# EAGLE schematic Resistor_Resistor (EAGLE 8.3.0), part 34 of 43
## Nets (continued)
N$81: R14401.2 R14402.2 R14403.2 R14404.2 R14405.2 R14406.2 R14407.2 R14408.2 R14409.2 R14410.2 R14411.2 R14412.2 R14413.2 R14414.2 R14415.2 R14416.2 R14417.2 R14418.2 R14419.2 R14420.2 R14421.2 R14422.2 R14423.2 R14424.2 R14425.2 R14426.2 R14427.2 R14428.2 R14429.2 R14430.2 R14431.2 R14432.2 R14433.2 R14434.2 R14435.2 R14436.2 R14437.2 R14438.2 R14439.2 R14440.2 R14441.2 R14442.2 R14443.2 R14444.2 R14445.2 R14446.2 R14447.2 R14448.2 R14449.2 R14450.2 R14451.2 R14452.2 R14453.2 R14454.2 R14455.2 R14456.2 R14457.2 R14458.2 R14459.2 R14460.2 R14461.2 R14462.2 R14463.2 R14464.2 R14465.2 R14466.2 R14467.2 R14468.2 R14469.2 R14470.2 R14471.2 R14472.2 R14473.2 R14474.2 R14475.2 R14476.2 R14477.2 R14478.2 R14479.2 R14480.2 R14481.2 R14482.2 R14483.2 R14484.2 R14485.2 R14486.2 R14487.2 R14488.2 R14489.2 R14490.2 R14491.2 R14492.2 R14493.2 R14494.2 R14495.2 R14496.2 R14497.2 R14498.2 R14499.2 R14500.2 R14501.2 R14502.2 R14503.2 R14504.2 R14505.2 R14506.2 R14507.2 R14508.2 R14509.2 R14510.2 R14511.2 R14512.2 R14513.2 R14514.2 R14515.2 R14516.2 R14517.2 R14518.2 R14519.2 R14520.2 R14521.2 R14522.2 R14523.2 R14524.2 R14525.2 R14526.2 R14527.2 R14528.2 R14529.2 R14530.2 R14531.2 R14532.2 R14533.2 R14534.2 R14535.2 R14536.2 R14537.2 R14538.2 R14539.2 R14540.2 R14541.2 R14542.2 R14543.2 R14544.2 R14545.2 R14546.2 R14547.2 R14548.2 R14549.2 R14550.2 R14551.2 R14552.2 R14553.2 R14554.2 R14555.2 R14556.2 R14557.2 R14558.2 R14559.2 R14560.2 R14561.2 R14562.2 R14563.2 R14564.2 R14565.2 R14566.2 R14567.2 R14568.2 R14569.2 R14570.2 R14571.2 R14572.2 R14573.2 R14574.2 R14575.2 R14576.2 R14577.2 R14578.2 R14579.2 R14580.2 R14581.2 R14582.2 R14583.2 R14584.2 R14585.2 R14586.2 R14587.2 R14588.2 R14589.2 R14590.2 R14591.2 R14592.2 R14593.2 R14594.2 R14595.2 R14596.2 R14597.2 R14598.2 R14599.2 R14600.2 R14601.1 R14602.1 R14603.1 R14604.1 R14605.1 R14606.1 R14607.1 R14608.1 R14609.1 R14610.1 R14611.1 R14612.1 R14613.1 R14614.1 R14615.1 R14616.1 R14617.1 R14618.1 R14619.1 R14620.1 R14621.1 R14622.1 R14623.1 R14624.1 R14625.1 R14626.1 R14627.1 R14628.1 R14629.1 R14630.1 R14631.1 R14632.1 R14633.1 R14634.1 R14635.1 R14636.1 R14637.1 R14638.1 R14639.1 R14640.1 R14641.1 R14642.1 R14643.1 R14644.1 R14645.1 R14646.1 R14647.1 R14648.1 R14649.1 R14650.1 R14651.1 R14652.1 R14653.1 R14654.1 R14655.1 R14656.1 R14657.1 R14658.1 R14659.1 R14660.1 R14661.1 R14662.1 R14663.1 R14664.1 R14665.1 R14666.1 R14667.1 R14668.1 R14669.1 R14670.1 R14671.1 R14672.1 R14673.1 R14674.1 R14675.1 R14676.1 R14677.1 R14678.1 R14679.1 R14680.1 R14681.1 R14682.1 R14683.1 R14684.1 R14685.1 R14686.1 R14687.1 R14688.1 R14689.1 R14690.1 R14691.1 R14692.1 R14693.1 R14694.1 R14695.1 R14696.1 R14697.1 R14698.1 R14699.1 R14700.1 R14701.1 R14702.1 R14703.1 R14704.1 R14705.1 R14706.1 R14707.1 R14708.1 R14709.1 R14710.1 R14711.1 R14712.1 R14713.1 R14714.1 R14715.1 R14716.1 R14717.1 R14718.1 R14719.1 R14720.1 R14721.1 R14722.1 R14723.1 R14724.1 R14725.1 R14726.1 R14727.1 R14728.1 R14729.1 R14730.1 R14731.1 R14732.1 R14733.1 R14734.1 R14735.1 R14736.1 R14737.1 R14738.1 R14739.1 R14740.1 R14741.1 R14742.1 R14743.1 R14744.1 R14745.1 R14746.1 R14747.1 R14748.1 R14749.1 R14750.1 R14751.1 R14752.1 R14753.1 R14754.1 R14755.1 R14756.1 R14757.1 R14758.1 R14759.1 R14760.1 R14761.1 R14762.1 R14763.1 R14764.1 R14765.1 R14766.1 R14767.1 R14768.1 R14769.1 R14770.1 R14771.1 R14772.1 R14773.1 R14774.1 R14775.1 R14776.1 R14777.1 R14778.1 R14779.1 R14780.1 R14781.1 R14782.1 R14783.1 R14784.1 R14785.1 R14786.1 R14787.1 R14788.1 R14789.1 R14790.1 R14791.1 R14792.1 R14793.1 R14794.1 R14795.1 R14796.1 R14797.1 R14798.1 R14799.1 R14800.1
N$82: R14601.2 R14602.2 R14603.2 R14604.2 R14605.2 R14606.2 R14607.2 R14608.2 R14609.2 R14610.2 R14611.2 R14612.2 R14613.2 R14614.2 R14615.2 R14616.2 R14617.2 R14618.2 R14619.2 R14620.2 R14621.2 R14622.2 R14623.2 R14624.2 R14625.2 R14626.2 R14627.2 R14628.2 R14629.2 R14630.2 R14631.2 R14632.2 R14633.2 R14634.2 R14635.2 R14636.2 R14637.2 R14638.2 R14639.2 R14640.2 R14641.2 R14642.2 R14643.2 R14644.2 R14645.2 R14646.2 R14647.2 R14648.2 R14649.2 R14650.2 R14651.2 R14652.2 R14653.2 R14654.2 R14655.2 R14656.2 R14657.2 R14658.2 R14659.2 R14660.2 R14661.2 R14662.2 R14663.2 R14664.2 R14665.2 R14666.2 R14667.2 R14668.2 R14669.2 R14670.2 R14671.2 R14672.2 R14673.2 R14674.2 R14675.2 R14676.2 R14677.2 R14678.2 R14679.2 R14680.2 R14681.2 R14682.2 R14683.2 R14684.2 R14685.2 R14686.2 R14687.2 R14688.2 R14689.2 R14690.2 R14691.2 R14692.2 R14693.2 R14694.2 R14695.2 R14696.2 R14697.2 R14698.2 R14699.2 R14700.2 R14701.2 R14702.2 R14703.2 R14704.2 R14705.2 R14706.2 R14707.2 R14708.2 R14709.2 R14710.2 R14711.2 R14712.2 R14713.2 R14714.2 R14715.2 R14716.2 R14717.2 R14718.2 R14719.2 R14720.2 R14721.2 R14722.2 R14723.2 R14724.2 R14725.2 R14726.2 R14727.2 R14728.2 R14729.2 R14730.2 R14731.2 R14732.2 R14733.2 R14734.2 R14735.2 R14736.2 R14737.2 R14738.2 R14739.2 R14740.2 R14741.2 R14742.2 R14743.2 R14744.2 R14745.2 R14746.2 R14747.2 R14748.2 R14749.2 R14750.2 R14751.2 R14752.2 R14753.2 R14754.2 R14755.2 R14756.2 R14757.2 R14758.2 R14759.2 R14760.2 R14761.2 R14762.2 R14763.2 R14764.2 R14765.2 R14766.2 R14767.2 R14768.2 R14769.2 R14770.2 R14771.2 R14772.2 R14773.2 R14774.2 R14775.2 R14776.2 R14777.2 R14778.2 R14779.2 R14780.2 R14781.2 R14782.2 R14783.2 R14784.2 R14785.2 R14786.2 R14787.2 R14788.2 R14789.2 R14790.2 R14791.2 R14792.2 R14793.2 R14794.2 R14795.2 R14796.2 R14797.2 R14798.2 R14799.2 R14800.2 R14801.1 R14802.1 R14803.1 R14804.1 R14805.1 R14806.1 R14807.1 R14808.1 R14809.1 R14810.1 R14811.1 R14812.1 R14813.1 R14814.1 R14815.1 R14816.1 R14817.1 R14818.1 R14819.1 R14820.1 R14821.1 R14822.1 R14823.1 R14824.1 R14825.1 R14826.1 R14827.1 R14828.1 R14829.1 R14830.1 R14831.1 R14832.1 R14833.1 R14834.1 R14835.1 R14836.1 R14837.1 R14838.1 R14839.1 R14840.1 R14841.1 R14842.1 R14843.1 R14844.1 R14845.1 R14846.1 R14847.1 R14848.1 R14849.1 R14850.1 R14851.1 R14852.1 R14853.1 R14854.1 R14855.1 R14856.1 R14857.1 R14858.1 R14859.1 R14860.1 R14861.1 R14862.1 R14863.1 R14864.1 R14865.1 R14866.1 R14867.1 R14868.1 R14869.1 R14870.1 R14871.1 R14872.1 R14873.1 R14874.1 R14875.1 R14876.1 R14877.1 R14878.1 R14879.1 R14880.1 R14881.1 R14882.1 R14883.1 R14884.1 R14885.1 R14886.1 R14887.1 R14888.1 R14889.1 R14890.1 R14891.1 R14892.1 R14893.1 R14894.1 R14895.1 R14896.1 R14897.1 R14898.1 R14899.1 R14900.1 R14901.1 R14902.1 R14903.1 R14904.1 R14905.1 R14906.1 R14907.1 R14908.1 R14909.1 R14910.1 R14911.1 R14912.1 R14913.1 R14914.1 R14915.1 R14916.1 R14917.1 R14918.1 R14919.1 R14920.1 R14921.1 R14922.1 R14923.1 R14924.1 R14925.1 R14926.1 R14927.1 R14928.1 R14929.1 R14930.1 R14931.1 R14932.1 R14933.1 R14934.1 R14935.1 R14936.1 R14937.1 R14938.1 R14939.1 R14940.1 R14941.1 R14942.1 R14943.1 R14944.1 R14945.1 R14946.1 R14947.1 R14948.1 R14949.1 R14950.1 R14951.1 R14952.1 R14953.1 R14954.1 R14955.1 R14956.1 R14957.1 R14958.1 R14959.1 R14960.1 R14961.1 R14962.1 R14963.1 R14964.1 R14965.1 R14966.1 R14967.1 R14968.1 R14969.1 R14970.1 R14971.1 R14972.1 R14973.1 R14974.1 R14975.1 R14976.1 R14977.1 R14978.1 R14979.1 R14980.1 R14981.1 R14982.1 R14983.1 R14984.1 R14985.1 R14986.1 R14987.1 R14988.1 R14989.1 R14990.1 R14991.1 R14992.1 R14993.1 R14994.1 R14995.1 R14996.1 R14997.1 R14998.1 R14999.1 R15000.1
N$83: R14801.2 R14802.2 R14803.2 R14804.2 R14805.2 R14806.2 R14807.2 R14808.2 R14809.2 R14810.2 R14811.2 R14812.2 R14813.2 R14814.2 R14815.2 R14816.2 R14817.2 R14818.2 R14819.2 R14820.2 R14821.2 R14822.2 R14823.2 R14824.2 R14825.2 R14826.2 R14827.2 R14828.2 R14829.2 R14830.2 R14831.2 R14832.2 R14833.2 R14834.2 R14835.2 R14836.2 R14837.2 R14838.2 R14839.2 R14840.2 R14841.2 R14842.2 R14843.2 R14844.2 R14845.2 R14846.2 R14847.2 R14848.2 R14849.2 R14850.2 R14851.2 R14852.2 R14853.2 R14854.2 R14855.2 R14856.2 R14857.2 R14858.2 R14859.2 R14860.2 R14861.2 R14862.2 R14863.2 R14864.2 R14865.2 R14866.2 R14867.2 R14868.2 R14869.2 R14870.2 R14871.2 R14872.2 R14873.2 R14874.2 R14875.2 R14876.2 R14877.2 R14878.2 R14879.2 R14880.2 R14881.2 R14882.2 R14883.2 R14884.2 R14885.2 R14886.2 R14887.2 R14888.2 R14889.2 R14890.2 R14891.2 R14892.2 R14893.2 R14894.2 R14895.2 R14896.2 R14897.2 R14898.2 R14899.2 R14900.2 R14901.2 R14902.2 R14903.2 R14904.2 R14905.2 R14906.2 R14907.2 R14908.2 R14909.2 R14910.2 R14911.2 R14912.2 R14913.2 R14914.2 R14915.2 R14916.2 R14917.2 R14918.2 R14919.2 R14920.2 R14921.2 R14922.2 R14923.2 R14924.2 R14925.2 R14926.2 R14927.2 R14928.2 R14929.2 R14930.2 R14931.2 R14932.2 R14933.2 R14934.2 R14935.2 R14936.2 R14937.2 R14938.2 R14939.2 R14940.2 R14941.2 R14942.2 R14943.2 R14944.2 R14945.2 R14946.2 R14947.2 R14948.2 R14949.2 R14950.2 R14951.2 R14952.2 R14953.2 R14954.2 R14955.2 R14956.2 R14957.2 R14958.2 R14959.2 R14960.2 R14961.2 R14962.2 R14963.2 R14964.2 R14965.2 R14966.2 R14967.2 R14968.2 R14969.2 R14970.2 R14971.2 R14972.2 R14973.2 R14974.2 R14975.2 R14976.2 R14977.2 R14978.2 R14979.2 R14980.2 R14981.2 R14982.2 R14983.2 R14984.2 R14985.2 R14986.2 R14987.2 R14988.2 R14989.2 R14990.2 R14991.2 R14992.2 R14993.2 R14994.2 R14995.2 R14996.2 R14997.2 R14998.2 R14999.2 R15000.2 R15001.1 R15002.1 R15003.1 R15004.1 R15005.1 R15006.1 R15007.1 R15008.1 R15009.1 R15010.1 R15011.1 R15012.1 R15013.1 R15014.1 R15015.1 R15016.1 R15017.1 R15018.1 R15019.1 R15020.1 R15021.1 R15022.1 R15023.1 R15024.1 R15025.1 R15026.1 R15027.1 R15028.1 R15029.1 R15030.1 R15031.1 R15032.1 R15033.1 R15034.1 R15035.1 R15036.1 R15037.1 R15038.1 R15039.1 R15040.1 R15041.1 R15042.1 R15043.1 R15044.1 R15045.1 R15046.1 R15047.1 R15048.1 R15049.1 R15050.1 R15051.1 R15052.1 R15053.1 R15054.1 R15055.1 R15056.1 R15057.1 R15058.1 R15059.1 R15060.1 R15061.1 R15062.1 R15063.1 R15064.1 R15065.1 R15066.1 R15067.1 R15068.1 R15069.1 R15070.1 R15071.1 R15072.1 R15073.1 R15074.1 R15075.1 R15076.1 R15077.1 R15078.1 R15079.1 R15080.1 R15081.1 R15082.1 R15083.1 R15084.1 R15085.1 R15086.1 R15087.1 R15088.1 R15089.1 R15090.1 R15091.1 R15092.1 R15093.1 R15094.1 R15095.1 R15096.1 R15097.1 R15098.1 R15099.1 R15100.1 R15101.1 R15102.1 R15103.1 R15104.1 R15105.1 R15106.1 R15107.1 R15108.1 R15109.1 R15110.1 R15111.1 R15112.1 R15113.1 R15114.1 R15115.1 R15116.1 R15117.1 R15118.1 R15119.1 R15120.1 R15121.1 R15122.1 R15123.1 R15124.1 R15125.1 R15126.1 R15127.1 R15128.1 R15129.1 R15130.1 R15131.1 R15132.1 R15133.1 R15134.1 R15135.1 R15136.1 R15137.1 R15138.1 R15139.1 R15140.1 R15141.1 R15142.1 R15143.1 R15144.1 R15145.1 R15146.1 R15147.1 R15148.1 R15149.1 R15150.1 R15151.1 R15152.1 R15153.1 R15154.1 R15155.1 R15156.1 R15157.1 R15158.1 R15159.1 R15160.1 R15161.1 R15162.1 R15163.1 R15164.1 R15165.1 R15166.1 R15167.1 R15168.1 R15169.1 R15170.1 R15171.1 R15172.1 R15173.1 R15174.1 R15175.1 R15176.1 R15177.1 R15178.1 R15179.1 R15180.1 R15181.1 R15182.1 R15183.1 R15184.1 R15185.1 R15186.1 R15187.1 R15188.1 R15189.1 R15190.1 R15191.1 R15192.1 R15193.1 R15194.1 R15195.1 R15196.1 R15197.1 R15198.1 R15199.1 R15200.1
N$84: R15001.2 R15002.2 R15003.2 R15004.2 R15005.2 R15006.2 R15007.2 R15008.2 R15009.2 R15010.2 R15011.2 R15012.2 R15013.2 R15014.2 R15015.2 R15016.2 R15017.2 R15018.2 R15019.2 R15020.2 R15021.2 R15022.2 R15023.2 R15024.2 R15025.2 R15026.2 R15027.2 R15028.2 R15029.2 R15030.2 R15031.2 R15032.2 R15033.2 R15034.2 R15035.2 R15036.2 R15037.2 R15038.2 R15039.2 R15040.2 R15041.2 R15042.2 R15043.2 R15044.2 R15045.2 R15046.2 R15047.2 R15048.2 R15049.2 R15050.2 R15051.2 R15052.2 R15053.2 R15054.2 R15055.2 R15056.2 R15057.2 R15058.2 R15059.2 R15060.2 R15061.2 R15062.2 R15063.2 R15064.2 R15065.2 R15066.2 R15067.2 R15068.2 R15069.2 R15070.2 R15071.2 R15072.2 R15073.2 R15074.2 R15075.2 R15076.2 R15077.2 R15078.2 R15079.2 R15080.2 R15081.2 R15082.2 R15083.2 R15084.2 R15085.2 R15086.2 R15087.2 R15088.2 R15089.2 R15090.2 R15091.2 R15092.2 R15093.2 R15094.2 R15095.2 R15096.2 R15097.2 R15098.2 R15099.2 R15100.2 R15101.2 R15102.2 R15103.2 R15104.2 R15105.2 R15106.2 R15107.2 R15108.2 R15109.2 R15110.2 R15111.2 R15112.2 R15113.2 R15114.2 R15115.2 R15116.2 R15117.2 R15118.2 R15119.2 R15120.2 R15121.2 R15122.2 R15123.2 R15124.2 R15125.2 R15126.2 R15127.2 R15128.2 R15129.2 R15130.2 R15131.2 R15132.2 R15133.2 R15134.2 R15135.2 R15136.2 R15137.2 R15138.2 R15139.2 R15140.2 R15141.2 R15142.2 R15143.2 R15144.2 R15145.2 R15146.2 R15147.2 R15148.2 R15149.2 R15150.2 R15151.2 R15152.2 R15153.2 R15154.2 R15155.2 R15156.2 R15157.2 R15158.2 R15159.2 R15160.2 R15161.2 R15162.2 R15163.2 R15164.2 R15165.2 R15166.2 R15167.2 R15168.2 R15169.2 R15170.2 R15171.2 R15172.2 R15173.2 R15174.2 R15175.2 R15176.2 R15177.2 R15178.2 R15179.2 R15180.2 R15181.2 R15182.2 R15183.2 R15184.2 R15185.2 R15186.2 R15187.2 R15188.2 R15189.2 R15190.2 R15191.2 R15192.2 R15193.2 R15194.2 R15195.2 R15196.2 R15197.2 R15198.2 R15199.2 R15200.2 R15201.1 R15202.1 R15203.1 R15204.1 R15205.1 R15206.1 R15207.1 R15208.1 R15209.1 R15210.1 R15211.1 R15212.1 R15213.1 R15214.1 R15215.1 R15216.1 R15217.1 R15218.1 R15219.1 R15220.1 R15221.1 R15222.1 R15223.1 R15224.1 R15225.1 R15226.1 R15227.1 R15228.1 R15229.1 R15230.1 R15231.1 R15232.1 R15233.1 R15234.1 R15235.1 R15236.1 R15237.1 R15238.1 R15239.1 R15240.1 R15241.1 R15242.1 R15243.1 R15244.1 R15245.1 R15246.1 R15247.1 R15248.1 R15249.1 R15250.1 R15251.1 R15252.1 R15253.1 R15254.1 R15255.1 R15256.1 R15257.1 R15258.1 R15259.1 R15260.1 R15261.1 R15262.1 R15263.1 R15264.1 R15265.1 R15266.1 R15267.1 R15268.1 R15269.1 R15270.1 R15271.1 R15272.1 R15273.1 R15274.1 R15275.1 R15276.1 R15277.1 R15278.1 R15279.1 R15280.1 R15281.1 R15282.1 R15283.1 R15284.1 R15285.1 R15286.1 R15287.1 R15288.1 R15289.1 R15290.1 R15291.1 R15292.1 R15293.1 R15294.1 R15295.1 R15296.1 R15297.1 R15298.1 R15299.1 R15300.1 R15301.1 R15302.1 R15303.1 R15304.1 R15305.1 R15306.1 R15307.1 R15308.1 R15309.1 R15310.1 R15311.1 R15312.1 R15313.1 R15314.1 R15315.1 R15316.1 R15317.1 R15318.1 R15319.1 R15320.1 R15321.1 R15322.1 R15323.1 R15324.1 R15325.1 R15326.1 R15327.1 R15328.1 R15329.1 R15330.1 R15331.1 R15332.1 R15333.1 R15334.1 R15335.1 R15336.1 R15337.1 R15338.1 R15339.1 R15340.1 R15341.1 R15342.1 R15343.1 R15344.1 R15345.1 R15346.1 R15347.1 R15348.1 R15349.1 R15350.1 R15351.1 R15352.1 R15353.1 R15354.1 R15355.1 R15356.1 R15357.1 R15358.1 R15359.1 R15360.1 R15361.1 R15362.1 R15363.1 R15364.1 R15365.1 R15366.1 R15367.1 R15368.1 R15369.1 R15370.1 R15371.1 R15372.1 R15373.1 R15374.1 R15375.1 R15376.1 R15377.1 R15378.1 R15379.1 R15380.1 R15381.1 R15382.1 R15383.1 R15384.1 R15385.1 R15386.1 R15387.1 R15388.1 R15389.1 R15390.1 R15391.1 R15392.1 R15393.1 R15394.1 R15395.1 R15396.1 R15397.1 R15398.1 R15399.1 R15400.1
N$85: R15201.2 R15202.2 R15203.2 R15204.2 R15205.2 R15206.2 R15207.2 R15208.2 R15209.2 R15210.2 R15211.2 R15212.2 R15213.2 R15214.2 R15215.2 R15216.2 R15217.2 R15218.2 R15219.2 R15220.2 R15221.2 R15222.2 R15223.2 R15224.2 R15225.2 R15226.2 R15227.2 R15228.2 R15229.2 R15230.2 R15231.2 R15232.2 R15233.2 R15234.2 R15235.2 R15236.2 R15237.2 R15238.2 R15239.2 R15240.2 R15241.2 R15242.2 R15243.2 R15244.2 R15245.2 R15246.2 R15247.2 R15248.2 R15249.2 R15250.2 R15251.2 R15252.2 R15253.2 R15254.2 R15255.2 R15256.2 R15257.2 R15258.2 R15259.2 R15260.2 R15261.2 R15262.2 R15263.2 R15264.2 R15265.2 R15266.2 R15267.2 R15268.2 R15269.2 R15270.2 R15271.2 R15272.2 R15273.2 R15274.2 R15275.2 R15276.2 R15277.2 R15278.2 R15279.2 R15280.2 R15281.2 R15282.2 R15283.2 R15284.2 R15285.2 R15286.2 R15287.2 R15288.2 R15289.2 R15290.2 R15291.2 R15292.2 R15293.2 R15294.2 R15295.2 R15296.2 R15297.2 R15298.2 R15299.2 R15300.2 R15301.2 R15302.2 R15303.2 R15304.2 R15305.2 R15306.2 R15307.2 R15308.2 R15309.2 R15310.2 R15311.2 R15312.2 R15313.2 R15314.2 R15315.2 R15316.2 R15317.2 R15318.2 R15319.2 R15320.2 R15321.2 R15322.2 R15323.2 R15324.2 R15325.2 R15326.2 R15327.2 R15328.2 R15329.2 R15330.2 R15331.2 R15332.2 R15333.2 R15334.2 R15335.2 R15336.2 R15337.2 R15338.2 R15339.2 R15340.2 R15341.2 R15342.2 R15343.2 R15344.2 R15345.2 R15346.2 R15347.2 R15348.2 R15349.2 R15350.2 R15351.2 R15352.2 R15353.2 R15354.2 R15355.2 R15356.2 R15357.2 R15358.2 R15359.2 R15360.2 R15361.2 R15362.2 R15363.2 R15364.2 R15365.2 R15366.2 R15367.2 R15368.2 R15369.2 R15370.2 R15371.2 R15372.2 R15373.2 R15374.2 R15375.2 R15376.2 R15377.2 R15378.2 R15379.2 R15380.2 R15381.2 R15382.2 R15383.2 R15384.2 R15385.2 R15386.2 R15387.2 R15388.2 R15389.2 R15390.2 R15391.2 R15392.2 R15393.2 R15394.2 R15395.2 R15396.2 R15397.2 R15398.2 R15399.2 R15400.2 R15401.1 R15402.1 R15403.1 R15404.1 R15405.1 R15406.1 R15407.1 R15408.1 R15409.1 R15410.1 R15411.1 R15412.1 R15413.1 R15414.1 R15415.1 R15416.1 R15417.1 R15418.1 R15419.1 R15420.1 R15421.1 R15422.1 R15423.1 R15424.1 R15425.1 R15426.1 R15427.1 R15428.1 R15429.1 R15430.1 R15431.1 R15432.1 R15433.1 R15434.1 R15435.1 R15436.1 R15437.1 R15438.1 R15439.1 R15440.1 R15441.1 R15442.1 R15443.1 R15444.1 R15445.1 R15446.1 R15447.1 R15448.1 R15449.1 R15450.1 R15451.1 R15452.1 R15453.1 R15454.1 R15455.1 R15456.1 R15457.1 R15458.1 R15459.1 R15460.1 R15461.1 R15462.1 R15463.1 R15464.1 R15465.1 R15466.1 R15467.1 R15468.1 R15469.1 R15470.1 R15471.1 R15472.1 R15473.1 R15474.1 R15475.1 R15476.1 R15477.1 R15478.1 R15479.1 R15480.1 R15481.1 R15482.1 R15483.1 R15484.1 R15485.1 R15486.1 R15487.1 R15488.1 R15489.1 R15490.1 R15491.1 R15492.1 R15493.1 R15494.1 R15495.1 R15496.1 R15497.1 R15498.1 R15499.1 R15500.1 R15501.1 R15502.1 R15503.1 R15504.1 R15505.1 R15506.1 R15507.1 R15508.1 R15509.1 R15510.1 R15511.1 R15512.1 R15513.1 R15514.1 R15515.1 R15516.1 R15517.1 R15518.1 R15519.1 R15520.1 R15521.1 R15522.1 R15523.1 R15524.1 R15525.1 R15526.1 R15527.1 R15528.1 R15529.1 R15530.1 R15531.1 R15532.1 R15533.1 R15534.1 R15535.1 R15536.1 R15537.1 R15538.1 R15539.1 R15540.1 R15541.1 R15542.1 R15543.1 R15544.1 R15545.1 R15546.1 R15547.1 R15548.1 R15549.1 R15550.1 R15551.1 R15552.1 R15553.1 R15554.1 R15555.1 R15556.1 R15557.1 R15558.1 R15559.1 R15560.1 R15561.1 R15562.1 R15563.1 R15564.1 R15565.1 R15566.1 R15567.1 R15568.1 R15569.1 R15570.1 R15571.1 R15572.1 R15573.1 R15574.1 R15575.1 R15576.1 R15577.1 R15578.1 R15579.1 R15580.1 R15581.1 R15582.1 R15583.1 R15584.1 R15585.1 R15586.1 R15587.1 R15588.1 R15589.1 R15590.1 R15591.1 R15592.1 R15593.1 R15594.1 R15595.1 R15596.1 R15597.1 R15598.1 R15599.1 R15600.1
N$86: R15401.2 R15402.2 R15403.2 R15404.2 R15405.2 R15406.2 R15407.2 R15408.2 R15409.2 R15410.2 R15411.2 R15412.2 R15413.2 R15414.2 R15415.2 R15416.2 R15417.2 R15418.2 R15419.2 R15420.2 R15421.2 R15422.2 R15423.2 R15424.2 R15425.2 R15426.2 R15427.2 R15428.2 R15429.2 R15430.2 R15431.2 R15432.2 R15433.2 R15434.2 R15435.2 R15436.2 R15437.2 R15438.2 R15439.2 R15440.2 R15441.2 R15442.2 R15443.2 R15444.2 R15445.2 R15446.2 R15447.2 R15448.2 R15449.2 R15450.2 R15451.2 R15452.2 R15453.2 R15454.2 R15455.2 R15456.2 R15457.2 R15458.2 R15459.2 R15460.2 R15461.2 R15462.2 R15463.2 R15464.2 R15465.2 R15466.2 R15467.2 R15468.2 R15469.2 R15470.2 R15471.2 R15472.2 R15473.2 R15474.2 R15475.2 R15476.2 R15477.2 R15478.2 R15479.2 R15480.2 R15481.2 R15482.2 R15483.2 R15484.2 R15485.2 R15486.2 R15487.2 R15488.2 R15489.2 R15490.2 R15491.2 R15492.2 R15493.2 R15494.2 R15495.2 R15496.2 R15497.2 R15498.2 R15499.2 R15500.2 R15501.2 R15502.2 R15503.2 R15504.2 R15505.2 R15506.2 R15507.2 R15508.2 R15509.2 R15510.2 R15511.2 R15512.2 R15513.2 R15514.2 R15515.2 R15516.2 R15517.2 R15518.2 R15519.2 R15520.2 R15521.2 R15522.2 R15523.2 R15524.2 R15525.2 R15526.2 R15527.2 R15528.2 R15529.2 R15530.2 R15531.2 R15532.2 R15533.2 R15534.2 R15535.2 R15536.2 R15537.2 R15538.2 R15539.2 R15540.2 R15541.2 R15542.2 R15543.2 R15544.2 R15545.2 R15546.2 R15547.2 R15548.2 R15549.2 R15550.2 R15551.2 R15552.2 R15553.2 R15554.2 R15555.2 R15556.2 R15557.2 R15558.2 R15559.2 R15560.2 R15561.2 R15562.2 R15563.2 R15564.2 R15565.2 R15566.2 R15567.2 R15568.2 R15569.2 R15570.2 R15571.2 R15572.2 R15573.2 R15574.2 R15575.2 R15576.2 R15577.2 R15578.2 R15579.2 R15580.2 R15581.2 R15582.2 R15583.2 R15584.2 R15585.2 R15586.2 R15587.2 R15588.2 R15589.2 R15590.2 R15591.2 R15592.2 R15593.2 R15594.2 R15595.2 R15596.2 R15597.2 R15598.2 R15599.2 R15600.2 R15601.1 R15602.1 R15603.1 R15604.1 R15605.1 R15606.1 R15607.1 R15608.1 R15609.1 R15610.1 R15611.1 R15612.1 R15613.1 R15614.1 R15615.1 R15616.1 R15617.1 R15618.1 R15619.1 R15620.1 R15621.1 R15622.1 R15623.1 R15624.1 R15625.1 R15626.1 R15627.1 R15628.1 R15629.1 R15630.1 R15631.1 R15632.1 R15633.1 R15634.1 R15635.1 R15636.1 R15637.1 R15638.1 R15639.1 R15640.1 R15641.1 R15642.1 R15643.1 R15644.1 R15645.1 R15646.1 R15647.1 R15648.1 R15649.1 R15650.1 R15651.1 R15652.1 R15653.1 R15654.1 R15655.1 R15656.1 R15657.1 R15658.1 R15659.1 R15660.1 R15661.1 R15662.1 R15663.1 R15664.1 R15665.1 R15666.1 R15667.1 R15668.1 R15669.1 R15670.1 R15671.1 R15672.1 R15673.1 R15674.1 R15675.1 R15676.1 R15677.1 R15678.1 R15679.1 R15680.1 R15681.1 R15682.1 R15683.1 R15684.1 R15685.1 R15686.1 R15687.1 R15688.1 R15689.1 R15690.1 R15691.1 R15692.1 R15693.1 R15694.1 R15695.1 R15696.1 R15697.1 R15698.1 R15699.1 R15700.1 R15701.1 R15702.1 R15703.1 R15704.1 R15705.1 R15706.1 R15707.1 R15708.1 R15709.1 R15710.1 R15711.1 R15712.1 R15713.1 R15714.1 R15715.1 R15716.1 R15717.1 R15718.1 R15719.1 R15720.1 R15721.1 R15722.1 R15723.1 R15724.1 R15725.1 R15726.1 R15727.1 R15728.1 R15729.1 R15730.1 R15731.1 R15732.1 R15733.1 R15734.1 R15735.1 R15736.1 R15737.1 R15738.1 R15739.1 R15740.1 R15741.1 R15742.1 R15743.1 R15744.1 R15745.1 R15746.1 R15747.1 R15748.1 R15749.1 R15750.1 R15751.1 R15752.1 R15753.1 R15754.1 R15755.1 R15756.1 R15757.1 R15758.1 R15759.1 R15760.1 R15761.1 R15762.1 R15763.1 R15764.1 R15765.1 R15766.1 R15767.1 R15768.1 R15769.1 R15770.1 R15771.1 R15772.1 R15773.1 R15774.1 R15775.1 R15776.1 R15777.1 R15778.1 R15779.1 R15780.1 R15781.1 R15782.1 R15783.1 R15784.1 R15785.1 R15786.1 R15787.1 R15788.1 R15789.1 R15790.1 R15791.1 R15792.1 R15793.1 R15794.1 R15795.1 R15796.1 R15797.1 R15798.1 R15799.1 R15800.1
N$87: R15601.2 R15602.2 R15603.2 R15604.2 R15605.2 R15606.2 R15607.2 R15608.2 R15609.2 R15610.2 R15611.2 R15612.2 R15613.2 R15614.2 R15615.2 R15616.2 R15617.2 R15618.2 R15619.2 R15620.2 R15621.2 R15622.2 R15623.2 R15624.2 R15625.2 R15626.2 R15627.2 R15628.2 R15629.2 R15630.2 R15631.2 R15632.2 R15633.2 R15634.2 R15635.2 R15636.2 R15637.2 R15638.2 R15639.2 R15640.2 R15641.2 R15642.2 R15643.2 R15644.2 R15645.2 R15646.2 R15647.2 R15648.2 R15649.2 R15650.2 R15651.2 R15652.2 R15653.2 R15654.2 R15655.2 R15656.2 R15657.2 R15658.2 R15659.2 R15660.2 R15661.2 R15662.2 R15663.2 R15664.2 R15665.2 R15666.2 R15667.2 R15668.2 R15669.2 R15670.2 R15671.2 R15672.2 R15673.2 R15674.2 R15675.2 R15676.2 R15677.2 R15678.2 R15679.2 R15680.2 R15681.2 R15682.2 R15683.2 R15684.2 R15685.2 R15686.2 R15687.2 R15688.2 R15689.2 R15690.2 R15691.2 R15692.2 R15693.2 R15694.2 R15695.2 R15696.2 R15697.2 R15698.2 R15699.2 R15700.2 R15701.2 R15702.2 R15703.2 R15704.2 R15705.2 R15706.2 R15707.2 R15708.2 R15709.2 R15710.2 R15711.2 R15712.2 R15713.2 R15714.2 R15715.2 R15716.2 R15717.2 R15718.2 R15719.2 R15720.2 R15721.2 R15722.2 R15723.2 R15724.2 R15725.2 R15726.2 R15727.2 R15728.2 R15729.2 R15730.2 R15731.2 R15732.2 R15733.2 R15734.2 R15735.2 R15736.2 R15737.2 R15738.2 R15739.2 R15740.2 R15741.2 R15742.2 R15743.2 R15744.2 R15745.2 R15746.2 R15747.2 R15748.2 R15749.2 R15750.2 R15751.2 R15752.2 R15753.2 R15754.2 R15755.2 R15756.2 R15757.2 R15758.2 R15759.2 R15760.2 R15761.2 R15762.2 R15763.2 R15764.2 R15765.2 R15766.2 R15767.2 R15768.2 R15769.2 R15770.2 R15771.2 R15772.2 R15773.2 R15774.2 R15775.2 R15776.2 R15777.2 R15778.2 R15779.2 R15780.2 R15781.2 R15782.2 R15783.2 R15784.2 R15785.2 R15786.2 R15787.2 R15788.2 R15789.2 R15790.2 R15791.2 R15792.2 R15793.2 R15794.2 R15795.2 R15796.2 R15797.2 R15798.2 R15799.2 R15800.2 R15801.1 R15802.1 R15803.1 R15804.1 R15805.1 R15806.1 R15807.1 R15808.1 R15809.1 R15810.1 R15811.1 R15812.1 R15813.1 R15814.1 R15815.1 R15816.1 R15817.1 R15818.1 R15819.1 R15820.1 R15821.1 R15822.1 R15823.1 R15824.1 R15825.1 R15826.1 R15827.1 R15828.1 R15829.1 R15830.1 R15831.1 R15832.1 R15833.1 R15834.1 R15835.1 R15836.1 R15837.1 R15838.1 R15839.1 R15840.1 R15841.1 R15842.1 R15843.1 R15844.1 R15845.1 R15846.1 R15847.1 R15848.1 R15849.1 R15850.1 R15851.1 R15852.1 R15853.1 R15854.1 R15855.1 R15856.1 R15857.1 R15858.1 R15859.1 R15860.1 R15861.1 R15862.1 R15863.1 R15864.1 R15865.1 R15866.1 R15867.1 R15868.1 R15869.1 R15870.1 R15871.1 R15872.1 R15873.1 R15874.1 R15875.1 R15876.1 R15877.1 R15878.1 R15879.1 R15880.1 R15881.1 R15882.1 R15883.1 R15884.1 R15885.1 R15886.1 R15887.1 R15888.1 R15889.1 R15890.1 R15891.1 R15892.1 R15893.1 R15894.1 R15895.1 R15896.1 R15897.1 R15898.1 R15899.1 R15900.1 R15901.1 R15902.1 R15903.1 R15904.1 R15905.1 R15906.1 R15907.1 R15908.1 R15909.1 R15910.1 R15911.1 R15912.1 R15913.1 R15914.1 R15915.1 R15916.1 R15917.1 R15918.1 R15919.1 R15920.1 R15921.1 R15922.1 R15923.1 R15924.1 R15925.1 R15926.1 R15927.1 R15928.1 R15929.1 R15930.1 R15931.1 R15932.1 R15933.1 R15934.1 R15935.1 R15936.1 R15937.1 R15938.1 R15939.1 R15940.1 R15941.1 R15942.1 R15943.1 R15944.1 R15945.1 R15946.1 R15947.1 R15948.1 R15949.1 R15950.1 R15951.1 R15952.1 R15953.1 R15954.1 R15955.1 R15956.1 R15957.1 R15958.1 R15959.1 R15960.1 R15961.1 R15962.1 R15963.1 R15964.1 R15965.1 R15966.1 R15967.1 R15968.1 R15969.1 R15970.1 R15971.1 R15972.1 R15973.1 R15974.1 R15975.1 R15976.1 R15977.1 R15978.1 R15979.1 R15980.1 R15981.1 R15982.1 R15983.1 R15984.1 R15985.1 R15986.1 R15987.1 R15988.1 R15989.1 R15990.1 R15991.1 R15992.1 R15993.1 R15994.1 R15995.1 R15996.1 R15997.1 R15998.1 R15999.1 R16000.1
N$88: R15801.2 R15802.2 R15803.2 R15804.2 R15805.2 R15806.2 R15807.2 R15808.2 R15809.2 R15810.2 R15811.2 R15812.2 R15813.2 R15814.2 R15815.2 R15816.2 R15817.2 R15818.2 R15819.2 R15820.2 R15821.2 R15822.2 R15823.2 R15824.2 R15825.2 R15826.2 R15827.2 R15828.2 R15829.2 R15830.2 R15831.2 R15832.2 R15833.2 R15834.2 R15835.2 R15836.2 R15837.2 R15838.2 R15839.2 R15840.2 R15841.2 R15842.2 R15843.2 R15844.2 R15845.2 R15846.2 R15847.2 R15848.2 R15849.2 R15850.2 R15851.2 R15852.2 R15853.2 R15854.2 R15855.2 R15856.2 R15857.2 R15858.2 R15859.2 R15860.2 R15861.2 R15862.2 R15863.2 R15864.2 R15865.2 R15866.2 R15867.2 R15868.2 R15869.2 R15870.2 R15871.2 R15872.2 R15873.2 R15874.2 R15875.2 R15876.2 R15877.2 R15878.2 R15879.2 R15880.2 R15881.2 R15882.2 R15883.2 R15884.2 R15885.2 R15886.2 R15887.2 R15888.2 R15889.2 R15890.2 R15891.2 R15892.2 R15893.2 R15894.2 R15895.2 R15896.2 R15897.2 R15898.2 R15899.2 R15900.2 R15901.2 R15902.2 R15903.2 R15904.2 R15905.2 R15906.2 R15907.2 R15908.2 R15909.2 R15910.2 R15911.2 R15912.2 R15913.2 R15914.2 R15915.2 R15916.2 R15917.2 R15918.2 R15919.2 R15920.2 R15921.2 R15922.2 R15923.2 R15924.2 R15925.2 R15926.2 R15927.2 R15928.2 R15929.2 R15930.2 R15931.2 R15932.2 R15933.2 R15934.2 R15935.2 R15936.2 R15937.2 R15938.2 R15939.2 R15940.2 R15941.2 R15942.2 R15943.2 R15944.2 R15945.2 R15946.2 R15947.2 R15948.2 R15949.2 R15950.2 R15951.2 R15952.2 R15953.2 R15954.2 R15955.2 R15956.2 R15957.2 R15958.2 R15959.2 R15960.2 R15961.2 R15962.2 R15963.2 R15964.2 R15965.2 R15966.2 R15967.2 R15968.2 R15969.2 R15970.2 R15971.2 R15972.2 R15973.2 R15974.2 R15975.2 R15976.2 R15977.2 R15978.2 R15979.2 R15980.2 R15981.2 R15982.2 R15983.2 R15984.2 R15985.2 R15986.2 R15987.2 R15988.2 R15989.2 R15990.2 R15991.2 R15992.2 R15993.2 R15994.2 R15995.2 R15996.2 R15997.2 R15998.2 R15999.2 R16000.2 R16001.1 R16002.1 R16003.1 R16004.1 R16005.1 R16006.1 R16007.1 R16008.1 R16009.1 R16010.1 R16011.1 R16012.1 R16013.1 R16014.1 R16015.1 R16016.1 R16017.1 R16018.1 R16019.1 R16020.1 R16021.1 R16022.1 R16023.1 R16024.1 R16025.1 R16026.1 R16027.1 R16028.1 R16029.1 R16030.1 R16031.1 R16032.1 R16033.1 R16034.1 R16035.1 R16036.1 R16037.1 R16038.1 R16039.1 R16040.1 R16041.1 R16042.1 R16043.1 R16044.1 R16045.1 R16046.1 R16047.1 R16048.1 R16049.1 R16050.1 R16051.1 R16052.1 R16053.1 R16054.1 R16055.1 R16056.1 R16057.1 R16058.1 R16059.1 R16060.1 R16061.1 R16062.1 R16063.1 R16064.1 R16065.1 R16066.1 R16067.1 R16068.1 R16069.1 R16070.1 R16071.1 R16072.1 R16073.1 R16074.1 R16075.1 R16076.1 R16077.1 R16078.1 R16079.1 R16080.1 R16081.1 R16082.1 R16083.1 R16084.1 R16085.1 R16086.1 R16087.1 R16088.1 R16089.1 R16090.1 R16091.1 R16092.1 R16093.1 R16094.1 R16095.1 R16096.1 R16097.1 R16098.1 R16099.1 R16100.1 R16101.1 R16102.1 R16103.1 R16104.1 R16105.1 R16106.1 R16107.1 R16108.1 R16109.1 R16110.1 R16111.1 R16112.1 R16113.1 R16114.1 R16115.1 R16116.1 R16117.1 R16118.1 R16119.1 R16120.1 R16121.1 R16122.1 R16123.1 R16124.1 R16125.1 R16126.1 R16127.1 R16128.1 R16129.1 R16130.1 R16131.1 R16132.1 R16133.1 R16134.1 R16135.1 R16136.1 R16137.1 R16138.1 R16139.1 R16140.1 R16141.1 R16142.1 R16143.1 R16144.1 R16145.1 R16146.1 R16147.1 R16148.1 R16149.1 R16150.1 R16151.1 R16152.1 R16153.1 R16154.1 R16155.1 R16156.1 R16157.1 R16158.1 R16159.1 R16160.1 R16161.1 R16162.1 R16163.1 R16164.1 R16165.1 R16166.1 R16167.1 R16168.1 R16169.1 R16170.1 R16171.1 R16172.1 R16173.1 R16174.1 R16175.1 R16176.1 R16177.1 R16178.1 R16179.1 R16180.1 R16181.1 R16182.1 R16183.1 R16184.1 R16185.1 R16186.1 R16187.1 R16188.1 R16189.1 R16190.1 R16191.1 R16192.1 R16193.1 R16194.1 R16195.1 R16196.1 R16197.1 R16198.1 R16199.1 R16200.1
N$89: R16001.2 R16002.2 R16003.2 R16004.2 R16005.2 R16006.2 R16007.2 R16008.2 R16009.2 R16010.2 R16011.2 R16012.2 R16013.2 R16014.2 R16015.2 R16016.2 R16017.2 R16018.2 R16019.2 R16020.2 R16021.2 R16022.2 R16023.2 R16024.2 R16025.2 R16026.2 R16027.2 R16028.2 R16029.2 R16030.2 R16031.2 R16032.2 R16033.2 R16034.2 R16035.2 R16036.2 R16037.2 R16038.2 R16039.2 R16040.2 R16041.2 R16042.2 R16043.2 R16044.2 R16045.2 R16046.2 R16047.2 R16048.2 R16049.2 R16050.2 R16051.2 R16052.2 R16053.2 R16054.2 R16055.2 R16056.2 R16057.2 R16058.2 R16059.2 R16060.2 R16061.2 R16062.2 R16063.2 R16064.2 R16065.2 R16066.2 R16067.2 R16068.2 R16069.2 R16070.2 R16071.2 R16072.2 R16073.2 R16074.2 R16075.2 R16076.2 R16077.2 R16078.2 R16079.2 R16080.2 R16081.2 R16082.2 R16083.2 R16084.2 R16085.2 R16086.2 R16087.2 R16088.2 R16089.2 R16090.2 R16091.2 R16092.2 R16093.2 R16094.2 R16095.2 R16096.2 R16097.2 R16098.2 R16099.2 R16100.2 R16101.2 R16102.2 R16103.2 R16104.2 R16105.2 R16106.2 R16107.2 R16108.2 R16109.2 R16110.2 R16111.2 R16112.2 R16113.2 R16114.2 R16115.2 R16116.2 R16117.2 R16118.2 R16119.2 R16120.2 R16121.2 R16122.2 R16123.2 R16124.2 R16125.2 R16126.2 R16127.2 R16128.2 R16129.2 R16130.2 R16131.2 R16132.2 R16133.2 R16134.2 R16135.2 R16136.2 R16137.2 R16138.2 R16139.2 R16140.2 R16141.2 R16142.2 R16143.2 R16144.2 R16145.2 R16146.2 R16147.2 R16148.2 R16149.2 R16150.2 R16151.2 R16152.2 R16153.2 R16154.2 R16155.2 R16156.2 R16157.2 R16158.2 R16159.2 R16160.2 R16161.2 R16162.2 R16163.2 R16164.2 R16165.2 R16166.2 R16167.2 R16168.2 R16169.2 R16170.2 R16171.2 R16172.2 R16173.2 R16174.2 R16175.2 R16176.2 R16177.2 R16178.2 R16179.2 R16180.2 R16181.2 R16182.2 R16183.2 R16184.2 R16185.2 R16186.2 R16187.2 R16188.2 R16189.2 R16190.2 R16191.2 R16192.2 R16193.2 R16194.2 R16195.2 R16196.2 R16197.2 R16198.2 R16199.2 R16200.2 R16201.1 R16202.1 R16203.1 R16204.1 R16205.1 R16206.1 R16207.1 R16208.1 R16209.1 R16210.1 R16211.1 R16212.1 R16213.1 R16214.1 R16215.1 R16216.1 R16217.1 R16218.1 R16219.1 R16220.1 R16221.1 R16222.1 R16223.1 R16224.1 R16225.1 R16226.1 R16227.1 R16228.1 R16229.1 R16230.1 R16231.1 R16232.1 R16233.1 R16234.1 R16235.1 R16236.1 R16237.1 R16238.1 R16239.1 R16240.1 R16241.1 R16242.1 R16243.1 R16244.1 R16245.1 R16246.1 R16247.1 R16248.1 R16249.1 R16250.1 R16251.1 R16252.1 R16253.1 R16254.1 R16255.1 R16256.1 R16257.1 R16258.1 R16259.1 R16260.1 R16261.1 R16262.1 R16263.1 R16264.1 R16265.1 R16266.1 R16267.1 R16268.1 R16269.1 R16270.1 R16271.1 R16272.1 R16273.1 R16274.1 R16275.1 R16276.1 R16277.1 R16278.1 R16279.1 R16280.1 R16281.1 R16282.1 R16283.1 R16284.1 R16285.1 R16286.1 R16287.1 R16288.1 R16289.1 R16290.1 R16291.1 R16292.1 R16293.1 R16294.1 R16295.1 R16296.1 R16297.1 R16298.1 R16299.1 R16300.1 R16301.1 R16302.1 R16303.1 R16304.1 R16305.1 R16306.1 R16307.1 R16308.1 R16309.1 R16310.1 R16311.1 R16312.1 R16313.1 R16314.1 R16315.1 R16316.1 R16317.1 R16318.1 R16319.1 R16320.1 R16321.1 R16322.1 R16323.1 R16324.1 R16325.1 R16326.1 R16327.1 R16328.1 R16329.1 R16330.1 R16331.1 R16332.1 R16333.1 R16334.1 R16335.1 R16336.1 R16337.1 R16338.1 R16339.1 R16340.1 R16341.1 R16342.1 R16343.1 R16344.1 R16345.1 R16346.1 R16347.1 R16348.1 R16349.1 R16350.1 R16351.1 R16352.1 R16353.1 R16354.1 R16355.1 R16356.1 R16357.1 R16358.1 R16359.1 R16360.1 R16361.1 R16362.1 R16363.1 R16364.1 R16365.1 R16366.1 R16367.1 R16368.1 R16369.1 R16370.1 R16371.1 R16372.1 R16373.1 R16374.1 R16375.1 R16376.1 R16377.1 R16378.1 R16379.1 R16380.1 R16381.1 R16382.1 R16383.1 R16384.1 R16385.1 R16386.1 R16387.1 R16388.1 R16389.1 R16390.1 R16391.1 R16392.1 R16393.1 R16394.1 R16395.1 R16396.1 R16397.1 R16398.1 R16399.1 R16400.1
N$90: R16201.2 R16202.2 R16203.2 R16204.2 R16205.2 R16206.2 R16207.2 R16208.2 R16209.2 R16210.2 R16211.2 R16212.2 R16213.2 R16214.2 R16215.2 R16216.2 R16217.2 R16218.2 R16219.2 R16220.2 R16221.2 R16222.2 R16223.2 R16224.2 R16225.2 R16226.2 R16227.2 R16228.2 R16229.2 R16230.2 R16231.2 R16232.2 R16233.2 R16234.2 R16235.2 R16236.2 R16237.2 R16238.2 R16239.2 R16240.2 R16241.2 R16242.2 R16243.2 R16244.2 R16245.2 R16246.2 R16247.2 R16248.2 R16249.2 R16250.2 R16251.2 R16252.2 R16253.2 R16254.2 R16255.2 R16256.2 R16257.2 R16258.2 R16259.2 R16260.2 R16261.2 R16262.2 R16263.2 R16264.2 R16265.2 R16266.2 R16267.2 R16268.2 R16269.2 R16270.2 R16271.2 R16272.2 R16273.2 R16274.2 R16275.2 R16276.2 R16277.2 R16278.2 R16279.2 R16280.2 R16281.2 R16282.2 R16283.2 R16284.2 R16285.2 R16286.2 R16287.2 R16288.2 R16289.2 R16290.2 R16291.2 R16292.2 R16293.2 R16294.2 R16295.2 R16296.2 R16297.2 R16298.2 R16299.2 R16300.2 R16301.2 R16302.2 R16303.2 R16304.2 R16305.2 R16306.2 R16307.2 R16308.2 R16309.2 R16310.2 R16311.2 R16312.2 R16313.2 R16314.2 R16315.2 R16316.2 R16317.2 R16318.2 R16319.2 R16320.2 R16321.2 R16322.2 R16323.2 R16324.2 R16325.2 R16326.2 R16327.2 R16328.2 R16329.2 R16330.2 R16331.2 R16332.2 R16333.2 R16334.2 R16335.2 R16336.2 R16337.2 R16338.2 R16339.2 R16340.2 R16341.2 R16342.2 R16343.2 R16344.2 R16345.2 R16346.2 R16347.2 R16348.2 R16349.2 R16350.2 R16351.2 R16352.2 R16353.2 R16354.2 R16355.2 R16356.2 R16357.2 R16358.2 R16359.2 R16360.2 R16361.2 R16362.2 R16363.2 R16364.2 R16365.2 R16366.2 R16367.2 R16368.2 R16369.2 R16370.2 R16371.2 R16372.2 R16373.2 R16374.2 R16375.2 R16376.2 R16377.2 R16378.2 R16379.2 R16380.2 R16381.2 R16382.2 R16383.2 R16384.2 R16385.2 R16386.2 R16387.2 R16388.2 R16389.2 R16390.2 R16391.2 R16392.2 R16393.2 R16394.2 R16395.2 R16396.2 R16397.2 R16398.2 R16399.2 R16400.2 R16401.1 R16402.1 R16403.1 R16404.1 R16405.1 R16406.1 R16407.1 R16408.1 R16409.1 R16410.1 R16411.1 R16412.1 R16413.1 R16414.1 R16415.1 R16416.1 R16417.1 R16418.1 R16419.1 R16420.1 R16421.1 R16422.1 R16423.1 R16424.1 R16425.1 R16426.1 R16427.1 R16428.1 R16429.1 R16430.1 R16431.1 R16432.1 R16433.1 R16434.1 R16435.1 R16436.1 R16437.1 R16438.1 R16439.1 R16440.1 R16441.1 R16442.1 R16443.1 R16444.1 R16445.1 R16446.1 R16447.1 R16448.1 R16449.1 R16450.1 R16451.1 R16452.1 R16453.1 R16454.1 R16455.1 R16456.1 R16457.1 R16458.1 R16459.1 R16460.1 R16461.1 R16462.1 R16463.1 R16464.1 R16465.1 R16466.1 R16467.1 R16468.1 R16469.1 R16470.1 R16471.1 R16472.1 R16473.1 R16474.1 R16475.1 R16476.1 R16477.1 R16478.1 R16479.1 R16480.1 R16481.1 R16482.1 R16483.1 R16484.1 R16485.1 R16486.1 R16487.1 R16488.1 R16489.1 R16490.1 R16491.1 R16492.1 R16493.1 R16494.1 R16495.1 R16496.1 R16497.1 R16498.1 R16499.1 R16500.1 R16501.1 R16502.1 R16503.1 R16504.1 R16505.1 R16506.1 R16507.1 R16508.1 R16509.1 R16510.1 R16511.1 R16512.1 R16513.1 R16514.1 R16515.1 R16516.1 R16517.1 R16518.1 R16519.1 R16520.1 R16521.1 R16522.1 R16523.1 R16524.1 R16525.1 R16526.1 R16527.1 R16528.1 R16529.1 R16530.1 R16531.1 R16532.1 R16533.1 R16534.1 R16535.1 R16536.1 R16537.1 R16538.1 R16539.1 R16540.1 R16541.1 R16542.1 R16543.1 R16544.1 R16545.1 R16546.1 R16547.1 R16548.1 R16549.1 R16550.1 R16551.1 R16552.1 R16553.1 R16554.1 R16555.1 R16556.1 R16557.1 R16558.1 R16559.1 R16560.1 R16561.1 R16562.1 R16563.1 R16564.1 R16565.1 R16566.1 R16567.1 R16568.1 R16569.1 R16570.1 R16571.1 R16572.1 R16573.1 R16574.1 R16575.1 R16576.1 R16577.1 R16578.1 R16579.1 R16580.1 R16581.1 R16582.1 R16583.1 R16584.1 R16585.1 R16586.1 R16587.1 R16588.1 R16589.1 R16590.1 R16591.1 R16592.1 R16593.1 R16594.1 R16595.1 R16596.1 R16597.1 R16598.1 R16599.1 R16600.1
N$91: R16401.2 R16402.2 R16403.2 R16404.2 R16405.2 R16406.2 R16407.2 R16408.2 R16409.2 R16410.2 R16411.2 R16412.2 R16413.2 R16414.2 R16415.2 R16416.2 R16417.2 R16418.2 R16419.2 R16420.2 R16421.2 R16422.2 R16423.2 R16424.2 R16425.2 R16426.2 R16427.2 R16428.2 R16429.2 R16430.2 R16431.2 R16432.2 R16433.2 R16434.2 R16435.2 R16436.2 R16437.2 R16438.2 R16439.2 R16440.2 R16441.2 R16442.2 R16443.2 R16444.2 R16445.2 R16446.2 R16447.2 R16448.2 R16449.2 R16450.2 R16451.2 R16452.2 R16453.2 R16454.2 R16455.2 R16456.2 R16457.2 R16458.2 R16459.2 R16460.2 R16461.2 R16462.2 R16463.2 R16464.2 R16465.2 R16466.2 R16467.2 R16468.2 R16469.2 R16470.2 R16471.2 R16472.2 R16473.2 R16474.2 R16475.2 R16476.2 R16477.2 R16478.2 R16479.2 R16480.2 R16481.2 R16482.2 R16483.2 R16484.2 R16485.2 R16486.2 R16487.2 R16488.2 R16489.2 R16490.2 R16491.2 R16492.2 R16493.2 R16494.2 R16495.2 R16496.2 R16497.2 R16498.2 R16499.2 R16500.2 R16501.2 R16502.2 R16503.2 R16504.2 R16505.2 R16506.2 R16507.2 R16508.2 R16509.2 R16510.2 R16511.2 R16512.2 R16513.2 R16514.2 R16515.2 R16516.2 R16517.2 R16518.2 R16519.2 R16520.2 R16521.2 R16522.2 R16523.2 R16524.2 R16525.2 R16526.2 R16527.2 R16528.2 R16529.2 R16530.2 R16531.2 R16532.2 R16533.2 R16534.2 R16535.2 R16536.2 R16537.2 R16538.2 R16539.2 R16540.2 R16541.2 R16542.2 R16543.2 R16544.2 R16545.2 R16546.2 R16547.2 R16548.2 R16549.2 R16550.2 R16551.2 R16552.2 R16553.2 R16554.2 R16555.2 R16556.2 R16557.2 R16558.2 R16559.2 R16560.2 R16561.2 R16562.2 R16563.2 R16564.2 R16565.2 R16566.2 R16567.2 R16568.2 R16569.2 R16570.2 R16571.2 R16572.2 R16573.2 R16574.2 R16575.2 R16576.2 R16577.2 R16578.2 R16579.2 R16580.2 R16581.2 R16582.2 R16583.2 R16584.2 R16585.2 R16586.2 R16587.2 R16588.2 R16589.2 R16590.2 R16591.2 R16592.2 R16593.2 R16594.2 R16595.2 R16596.2 R16597.2 R16598.2 R16599.2 R16600.2 R16601.1 R16602.1 R16603.1 R16604.1 R16605.1 R16606.1 R16607.1 R16608.1 R16609.1 R16610.1 R16611.1 R16612.1 R16613.1 R16614.1 R16615.1 R16616.1 R16617.1 R16618.1 R16619.1 R16620.1 R16621.1 R16622.1 R16623.1 R16624.1 R16625.1 R16626.1 R16627.1 R16628.1 R16629.1 R16630.1 R16631.1 R16632.1 R16633.1 R16634.1 R16635.1 R16636.1 R16637.1 R16638.1 R16639.1 R16640.1 R16641.1 R16642.1 R16643.1 R16644.1 R16645.1 R16646.1 R16647.1 R16648.1 R16649.1 R16650.1 R16651.1 R16652.1 R16653.1 R16654.1 R16655.1 R16656.1 R16657.1 R16658.1 R16659.1 R16660.1 R16661.1 R16662.1 R16663.1 R16664.1 R16665.1 R16666.1 R16667.1 R16668.1 R16669.1 R16670.1 R16671.1 R16672.1 R16673.1 R16674.1 R16675.1 R16676.1 R16677.1 R16678.1 R16679.1 R16680.1 R16681.1 R16682.1 R16683.1 R16684.1 R16685.1 R16686.1 R16687.1 R16688.1 R16689.1 R16690.1 R16691.1 R16692.1 R16693.1 R16694.1 R16695.1 R16696.1 R16697.1 R16698.1 R16699.1 R16700.1 R16701.1 R16702.1 R16703.1 R16704.1 R16705.1 R16706.1 R16707.1 R16708.1 R16709.1 R16710.1 R16711.1 R16712.1 R16713.1 R16714.1 R16715.1 R16716.1 R16717.1 R16718.1 R16719.1 R16720.1 R16721.1 R16722.1 R16723.1 R16724.1 R16725.1 R16726.1 R16727.1 R16728.1 R16729.1 R16730.1 R16731.1 R16732.1 R16733.1 R16734.1 R16735.1 R16736.1 R16737.1 R16738.1 R16739.1 R16740.1 R16741.1 R16742.1 R16743.1 R16744.1 R16745.1 R16746.1 R16747.1 R16748.1 R16749.1 R16750.1 R16751.1 R16752.1 R16753.1 R16754.1 R16755.1 R16756.1 R16757.1 R16758.1 R16759.1 R16760.1 R16761.1 R16762.1 R16763.1 R16764.1 R16765.1 R16766.1 R16767.1 R16768.1 R16769.1 R16770.1 R16771.1 R16772.1 R16773.1 R16774.1 R16775.1 R16776.1 R16777.1 R16778.1 R16779.1 R16780.1 R16781.1 R16782.1 R16783.1 R16784.1 R16785.1 R16786.1 R16787.1 R16788.1 R16789.1 R16790.1 R16791.1 R16792.1 R16793.1 R16794.1 R16795.1 R16796.1 R16797.1 R16798.1 R16799.1 R16800.1
N$92: R16601.2 R16602.2 R16603.2 R16604.2 R16605.2 R16606.2 R16607.2 R16608.2 R16609.2 R16610.2 R16611.2 R16612.2 R16613.2 R16614.2 R16615.2 R16616.2 R16617.2 R16618.2 R16619.2 R16620.2 R16621.2 R16622.2 R16623.2 R16624.2 R16625.2 R16626.2 R16627.2 R16628.2 R16629.2 R16630.2 R16631.2 R16632.2 R16633.2 R16634.2 R16635.2 R16636.2 R16637.2 R16638.2 R16639.2 R16640.2 R16641.2 R16642.2 R16643.2 R16644.2 R16645.2 R16646.2 R16647.2 R16648.2 R16649.2 R16650.2 R16651.2 R16652.2 R16653.2 R16654.2 R16655.2 R16656.2 R16657.2 R16658.2 R16659.2 R16660.2 R16661.2 R16662.2 R16663.2 R16664.2 R16665.2 R16666.2 R16667.2 R16668.2 R16669.2 R16670.2 R16671.2 R16672.2 R16673.2 R16674.2 R16675.2 R16676.2 R16677.2 R16678.2 R16679.2 R16680.2 R16681.2 R16682.2 R16683.2 R16684.2 R16685.2 R16686.2 R16687.2 R16688.2 R16689.2 R16690.2 R16691.2 R16692.2 R16693.2 R16694.2 R16695.2 R16696.2 R16697.2 R16698.2 R16699.2 R16700.2 R16701.2 R16702.2 R16703.2 R16704.2 R16705.2 R16706.2 R16707.2 R16708.2 R16709.2 R16710.2 R16711.2 R16712.2 R16713.2 R16714.2 R16715.2 R16716.2 R16717.2 R16718.2 R16719.2 R16720.2 R16721.2 R16722.2 R16723.2 R16724.2 R16725.2 R16726.2 R16727.2 R16728.2 R16729.2 R16730.2 R16731.2 R16732.2 R16733.2 R16734.2 R16735.2 R16736.2 R16737.2 R16738.2 R16739.2 R16740.2 R16741.2 R16742.2 R16743.2 R16744.2 R16745.2 R16746.2 R16747.2 R16748.2 R16749.2 R16750.2 R16751.2 R16752.2 R16753.2 R16754.2 R16755.2 R16756.2 R16757.2 R16758.2 R16759.2 R16760.2 R16761.2 R16762.2 R16763.2 R16764.2 R16765.2 R16766.2 R16767.2 R16768.2 R16769.2 R16770.2 R16771.2 R16772.2 R16773.2 R16774.2 R16775.2 R16776.2 R16777.2 R16778.2 R16779.2 R16780.2 R16781.2 R16782.2 R16783.2 R16784.2 R16785.2 R16786.2 R16787.2 R16788.2 R16789.2 R16790.2 R16791.2 R16792.2 R16793.2 R16794.2 R16795.2 R16796.2 R16797.2 R16798.2 R16799.2 R16800.2 R16801.1 R16802.1 R16803.1 R16804.1 R16805.1 R16806.1 R16807.1 R16808.1 R16809.1 R16810.1 R16811.1 R16812.1 R16813.1 R16814.1 R16815.1 R16816.1 R16817.1 R16818.1 R16819.1 R16820.1 R16821.1 R16822.1 R16823.1 R16824.1 R16825.1 R16826.1 R16827.1 R16828.1 R16829.1 R16830.1 R16831.1 R16832.1 R16833.1 R16834.1 R16835.1 R16836.1 R16837.1 R16838.1 R16839.1 R16840.1 R16841.1 R16842.1 R16843.1 R16844.1 R16845.1 R16846.1 R16847.1 R16848.1 R16849.1 R16850.1 R16851.1 R16852.1 R16853.1 R16854.1 R16855.1 R16856.1 R16857.1 R16858.1 R16859.1 R16860.1 R16861.1 R16862.1 R16863.1 R16864.1 R16865.1 R16866.1 R16867.1 R16868.1 R16869.1 R16870.1 R16871.1 R16872.1 R16873.1 R16874.1 R16875.1 R16876.1 R16877.1 R16878.1 R16879.1 R16880.1 R16881.1 R16882.1 R16883.1 R16884.1 R16885.1 R16886.1 R16887.1 R16888.1 R16889.1 R16890.1 R16891.1 R16892.1 R16893.1 R16894.1 R16895.1 R16896.1 R16897.1 R16898.1 R16899.1 R16900.1 R16901.1 R16902.1 R16903.1 R16904.1 R16905.1 R16906.1 R16907.1 R16908.1 R16909.1 R16910.1 R16911.1 R16912.1 R16913.1 R16914.1 R16915.1 R16916.1 R16917.1 R16918.1 R16919.1 R16920.1 R16921.1 R16922.1 R16923.1 R16924.1 R16925.1 R16926.1 R16927.1 R16928.1 R16929.1 R16930.1 R16931.1 R16932.1 R16933.1 R16934.1 R16935.1 R16936.1 R16937.1 R16938.1 R16939.1 R16940.1 R16941.1 R16942.1 R16943.1 R16944.1 R16945.1 R16946.1 R16947.1 R16948.1 R16949.1 R16950.1 R16951.1 R16952.1 R16953.1 R16954.1 R16955.1 R16956.1 R16957.1 R16958.1 R16959.1 R16960.1 R16961.1 R16962.1 R16963.1 R16964.1 R16965.1 R16966.1 R16967.1 R16968.1 R16969.1 R16970.1 R16971.1 R16972.1 R16973.1 R16974.1 R16975.1 R16976.1 R16977.1 R16978.1 R16979.1 R16980.1 R16981.1 R16982.1 R16983.1 R16984.1 R16985.1 R16986.1 R16987.1 R16988.1 R16989.1 R16990.1 R16991.1 R16992.1 R16993.1 R16994.1 R16995.1 R16996.1 R16997.1 R16998.1 R16999.1 R17000.1
N$93: R16801.2 R16802.2 R16803.2 R16804.2 R16805.2 R16806.2 R16807.2 R16808.2 R16809.2 R16810.2 R16811.2 R16812.2 R16813.2 R16814.2 R16815.2 R16816.2 R16817.2 R16818.2 R16819.2 R16820.2 R16821.2 R16822.2 R16823.2 R16824.2 R16825.2 R16826.2 R16827.2 R16828.2 R16829.2 R16830.2 R16831.2 R16832.2 R16833.2 R16834.2 R16835.2 R16836.2 R16837.2 R16838.2 R16839.2 R16840.2 R16841.2 R16842.2 R16843.2 R16844.2 R16845.2 R16846.2 R16847.2 R16848.2 R16849.2 R16850.2 R16851.2 R16852.2 R16853.2 R16854.2 R16855.2 R16856.2 R16857.2 R16858.2 R16859.2 R16860.2 R16861.2 R16862.2 R16863.2 R16864.2 R16865.2 R16866.2 R16867.2 R16868.2 R16869.2 R16870.2 R16871.2 R16872.2 R16873.2 R16874.2 R16875.2 R16876.2 R16877.2 R16878.2 R16879.2 R16880.2 R16881.2 R16882.2 R16883.2 R16884.2 R16885.2 R16886.2 R16887.2 R16888.2 R16889.2 R16890.2 R16891.2 R16892.2 R16893.2 R16894.2 R16895.2 R16896.2 R16897.2 R16898.2 R16899.2 R16900.2 R16901.2 R16902.2 R16903.2 R16904.2 R16905.2 R16906.2 R16907.2 R16908.2 R16909.2 R16910.2 R16911.2 R16912.2 R16913.2 R16914.2 R16915.2 R16916.2 R16917.2 R16918.2 R16919.2 R16920.2 R16921.2 R16922.2 R16923.2 R16924.2 R16925.2 R16926.2 R16927.2 R16928.2 R16929.2 R16930.2 R16931.2 R16932.2 R16933.2 R16934.2 R16935.2 R16936.2 R16937.2 R16938.2 R16939.2 R16940.2 R16941.2 R16942.2 R16943.2 R16944.2 R16945.2 R16946.2 R16947.2 R16948.2 R16949.2 R16950.2 R16951.2 R16952.2 R16953.2 R16954.2 R16955.2 R16956.2 R16957.2 R16958.2 R16959.2 R16960.2 R16961.2 R16962.2 R16963.2 R16964.2 R16965.2 R16966.2 R16967.2 R16968.2 R16969.2 R16970.2 R16971.2 R16972.2 R16973.2 R16974.2 R16975.2 R16976.2 R16977.2 R16978.2 R16979.2 R16980.2 R16981.2 R16982.2 R16983.2 R16984.2 R16985.2 R16986.2 R16987.2 R16988.2 R16989.2 R16990.2 R16991.2 R16992.2 R16993.2 R16994.2 R16995.2 R16996.2 R16997.2 R16998.2 R16999.2 R17000.2 R17001.1 R17002.1 R17003.1 R17004.1 R17005.1 R17006.1 R17007.1 R17008.1 R17009.1 R17010.1 R17011.1 R17012.1 R17013.1 R17014.1 R17015.1 R17016.1 R17017.1 R17018.1 R17019.1 R17020.1 R17021.1 R17022.1 R17023.1 R17024.1 R17025.1 R17026.1 R17027.1 R17028.1 R17029.1 R17030.1 R17031.1 R17032.1 R17033.1 R17034.1 R17035.1 R17036.1 R17037.1 R17038.1 R17039.1 R17040.1 R17041.1 R17042.1 R17043.1 R17044.1 R17045.1 R17046.1 R17047.1 R17048.1 R17049.1 R17050.1 R17051.1 R17052.1 R17053.1 R17054.1 R17055.1 R17056.1 R17057.1 R17058.1 R17059.1 R17060.1 R17061.1 R17062.1 R17063.1 R17064.1 R17065.1 R17066.1 R17067.1 R17068.1 R17069.1 R17070.1 R17071.1 R17072.1 R17073.1 R17074.1 R17075.1 R17076.1 R17077.1 R17078.1 R17079.1 R17080.1 R17081.1 R17082.1 R17083.1 R17084.1 R17085.1 R17086.1 R17087.1 R17088.1 R17089.1 R17090.1 R17091.1 R17092.1 R17093.1 R17094.1 R17095.1 R17096.1 R17097.1 R17098.1 R17099.1 R17100.1 R17101.1 R17102.1 R17103.1 R17104.1 R17105.1 R17106.1 R17107.1 R17108.1 R17109.1 R17110.1 R17111.1 R17112.1 R17113.1 R17114.1 R17115.1 R17116.1 R17117.1 R17118.1 R17119.1 R17120.1 R17121.1 R17122.1 R17123.1 R17124.1 R17125.1 R17126.1 R17127.1 R17128.1 R17129.1 R17130.1 R17131.1 R17132.1 R17133.1 R17134.1 R17135.1 R17136.1 R17137.1 R17138.1 R17139.1 R17140.1 R17141.1 R17142.1 R17143.1 R17144.1 R17145.1 R17146.1 R17147.1 R17148.1 R17149.1 R17150.1 R17151.1 R17152.1 R17153.1 R17154.1 R17155.1 R17156.1 R17157.1 R17158.1 R17159.1 R17160.1 R17161.1 R17162.1 R17163.1 R17164.1 R17165.1 R17166.1 R17167.1 R17168.1 R17169.1 R17170.1 R17171.1 R17172.1 R17173.1 R17174.1 R17175.1 R17176.1 R17177.1 R17178.1 R17179.1 R17180.1 R17181.1 R17182.1 R17183.1 R17184.1 R17185.1 R17186.1 R17187.1 R17188.1 R17189.1 R17190.1 R17191.1 R17192.1 R17193.1 R17194.1 R17195.1 R17196.1 R17197.1 R17198.1 R17199.1 R17200.1